# EasyEDA Pro project ProProject_IMUSensorNodes202312.epro, schematic 逆时针
Create Date: 2023-12-26; Page Name: P1; Project Name: IMUSensorNodes202312; Schematic Name: 逆时针; Update Date: 2024-01-22; Company: 嘉立创EDA; Page Size: A4; Version: V1.0
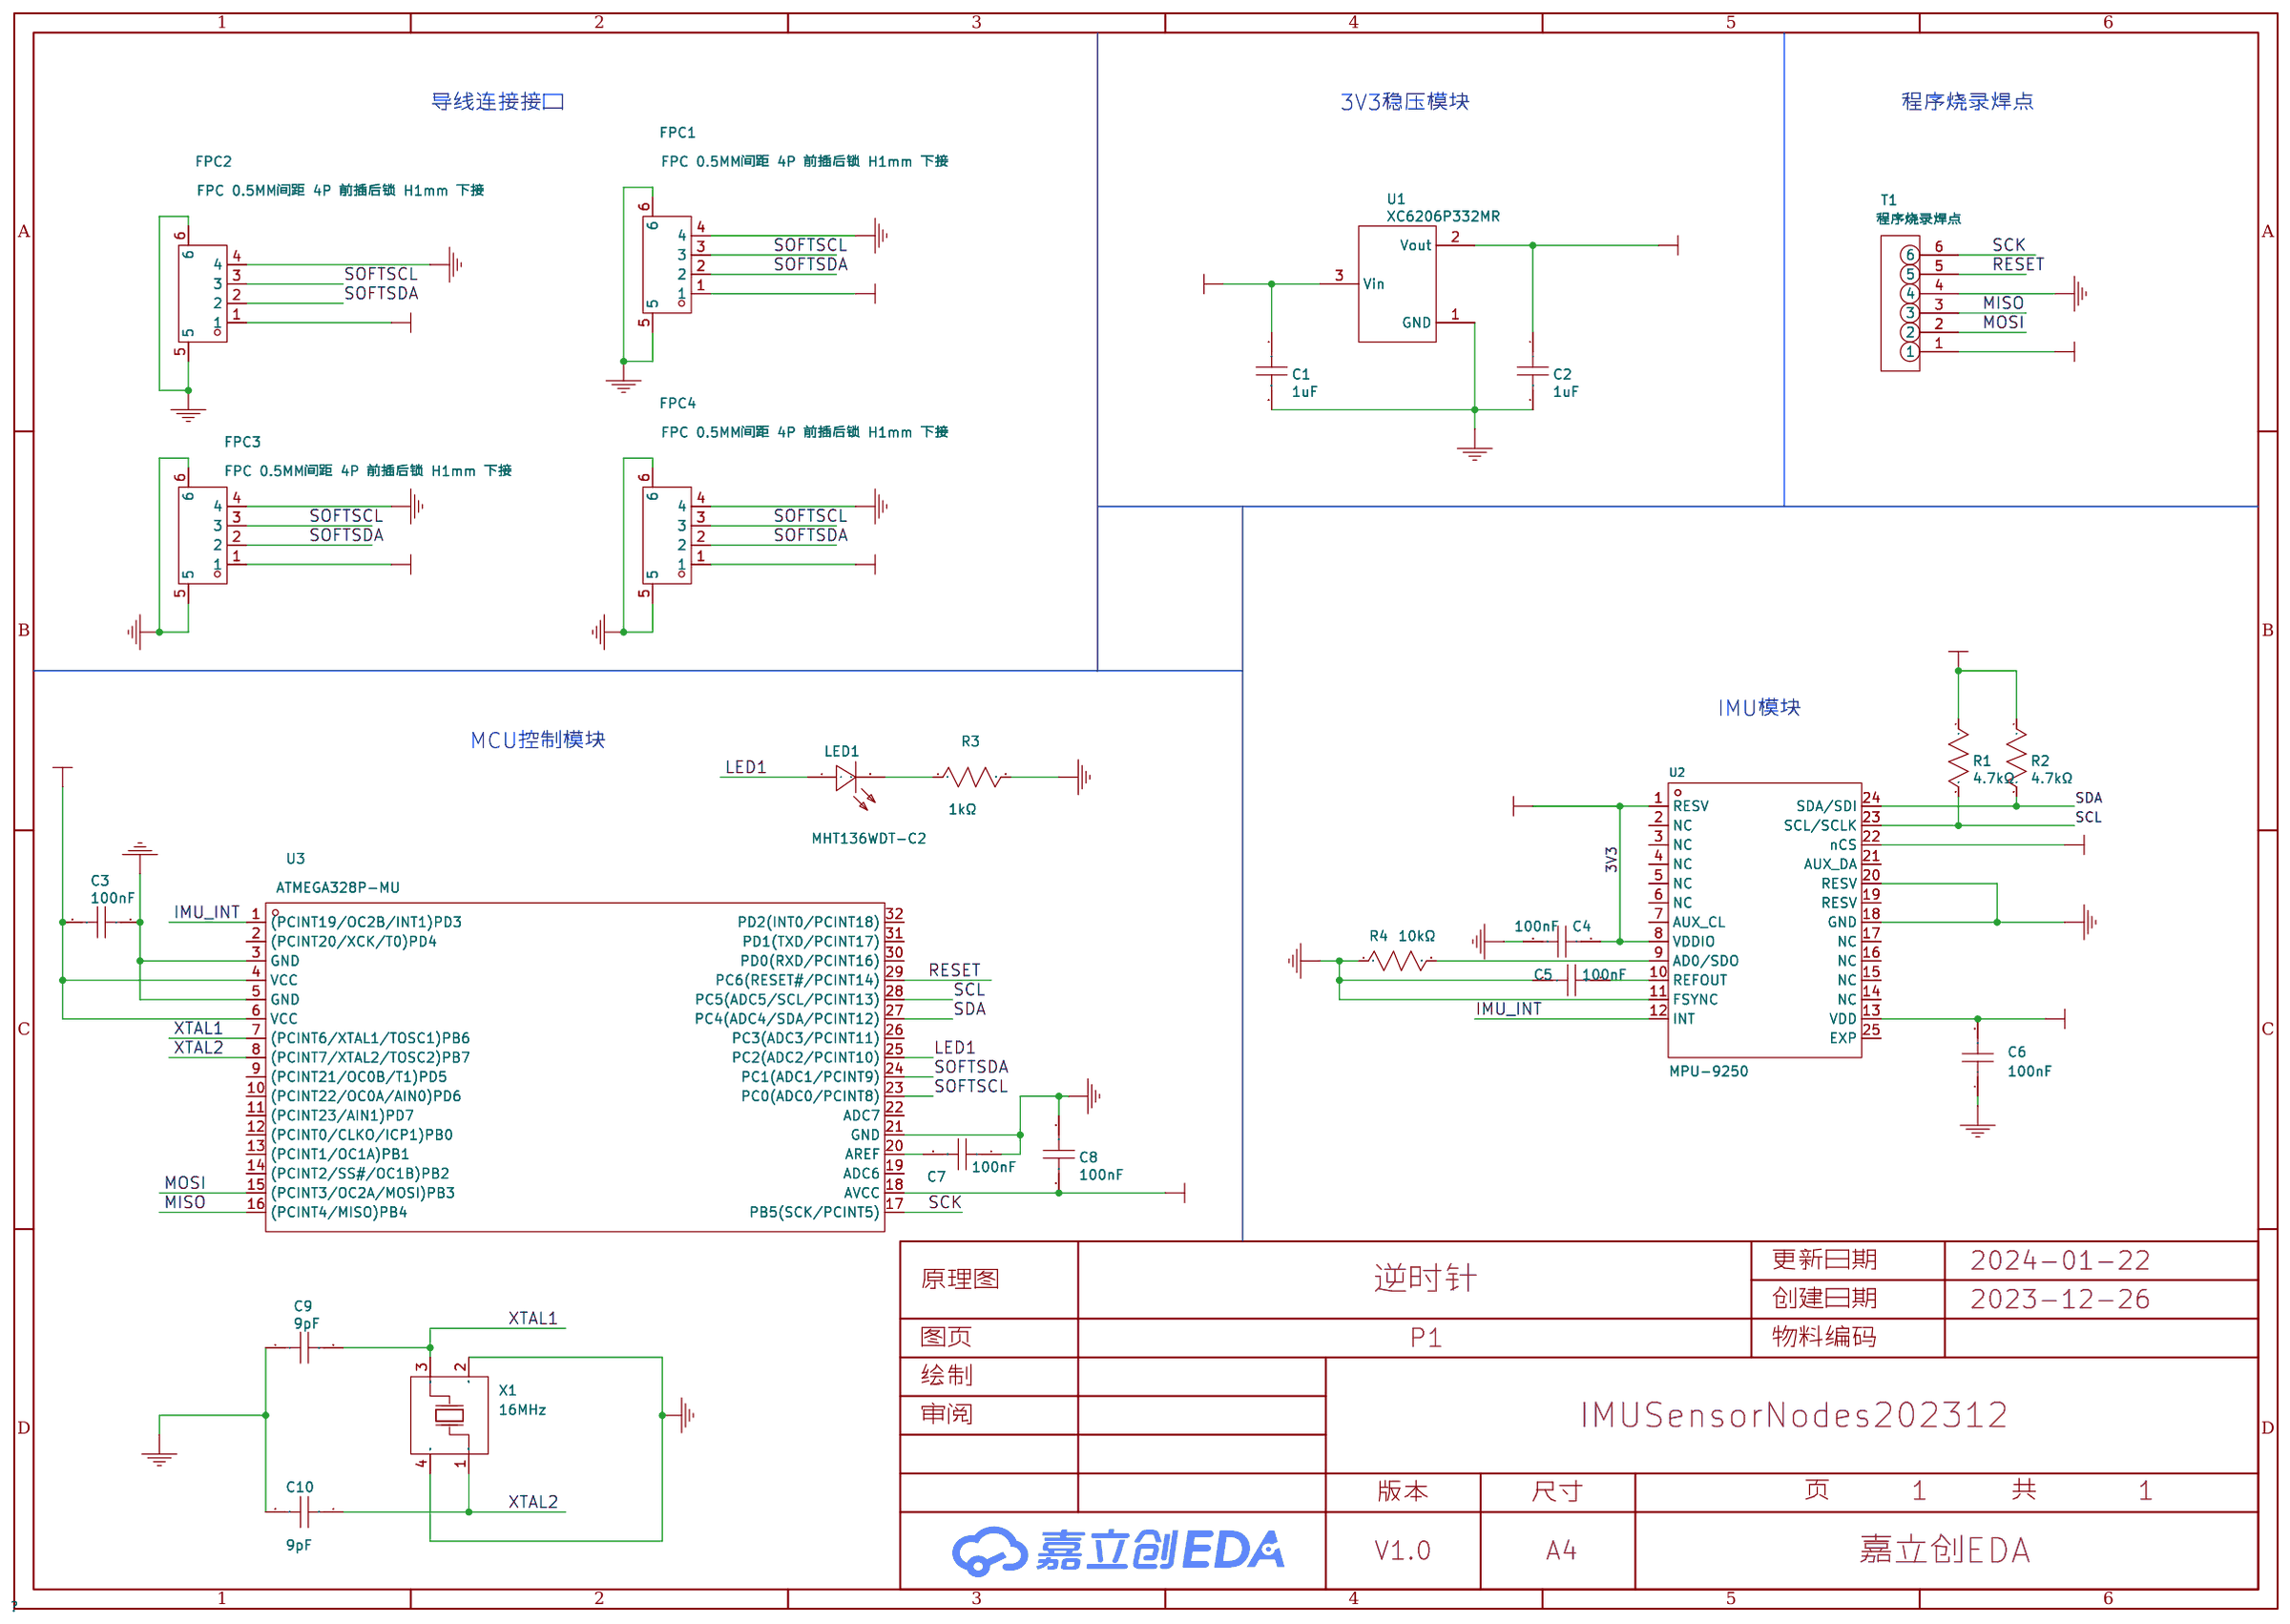
[diagram p1: schematic sheet]

## Parts
C1  1uF  [C0201]
C2  1uF  [C0201]
C3  100nF  [C0201]
C4  100nF  [C0201]
C5  100nF  [C0201]
C6  100nF  [C0201]
C7  100nF  [C0201]
C8  100nF  [C0201]
C9  9pF  [C0201]
C10  9pF  [C0201]
FPC1  FPC 0.5MM间距 4P 前插后锁 H1mm 下接  [FPC-0.5MM-4P-H1.0]
FPC2  FPC 0.5MM间距 4P 前插后锁 H1mm 下接  [FPC-0.5MM-4P-H1.0]
FPC3  FPC 0.5MM间距 4P 前插后锁 H1mm 下接  [FPC-0.5MM-4P-H1.0]
FPC4  FPC 0.5MM间距 4P 前插后锁 H1mm 下接  [FPC-0.5MM-4P-H1.0]
LED1  MHT136WDT-C2  [LED0402]
R1  4.7kΩ  [R0201]
R2  4.7kΩ  [R0201]
R3  1kΩ  [R0201]
R4  10kΩ  [R0201]
T1  程序烧录焊点  [TEST]
U1  XC6206P332MR  [SOT-23-3_L2.9-W1.6-P1.90-LS2.8-BR]
U2  MPU-9250  [QFN-24_L3.0-W3.0-P0.40-BL-EP]
U3  ATMEGA328P-MU  [VQFN-32_L5.0-W5.0-P0.50-TL-EP3.1]
X1  16MHz  [CRYSTAL-SMD_4P-L1.6-W1.2-BL]

## Library data of the parts
C1 C2 = GRM033R61A105ME44D: 容值:1uF;精度:±20%;额定电压:10V;材质(温度系数):X5R;; LCSC Part Name: 1uF ±20% 10V; Supplier Part: C76935; Manufacturer: muRata(村田); Supplier Footprint: 0201; JLCPCB Part Class: Extended Part; Datasheet: https://atta.szlcsc.com/upload/public/pdf/source/20190904/C426118_85E81C7C1F21FC87C5FB6D536E0847B4.pdf; Supplier: LCSC; Tolerance: ±20%; Voltage Rated: 10V; Temperature Coefficient: X5R; Check: true
C3-C8 = 0201X104K100NT: 容值:100nF;精度:±10%;额定电压:10V;材质(温度系数):X5R;; LCSC Part Name: 100nF ±10% 10V; Supplier Part: C284966; Manufacturer: FH(风华); Supplier Footprint: 0201; JLCPCB Part Class: Extended Part; Datasheet: https://atta.szlcsc.com/upload/public/pdf/source/20200305/C486355_26A10D38EF8C2A5C37091D0039909270.pdf; Supplier: LCSC; Tolerance: ±10%; Voltage Rated: 10V; Temperature Coefficient: X5R; Check: true
C9 C10 = GRM0335C1H9R0BA01D: 容值:9pF;额定电压:50V;材质(温度系数):C0G;; LCSC Part Name: 9pF 50V ±0.1pF; Supplier Part: C161443; Manufacturer: muRata(村田); Supplier Footprint: 0201; JLCPCB Part Class: Extended Part; Datasheet: https://atta.szlcsc.com/upload/public/pdf/source/20190418/C161443_6F26B16708DF6E91A07DC3E31260E8F5.pdf; Supplier: LCSC; Voltage Rated: 50V; Temperature Coefficient: C0G; Check: true
FPC1-FPC4 = FPC 0.5MM 4P 翻盖式 H2.0: Supplier: LCSC; Supplier Part: C9345; Manufacturer: ATOM(爱特姆); JLCPCB Part Class: Extended Part; Check: true
LED1 = MHT136WDT-C2: 发光颜色:白色;二极管配置:-;功率:95mW;透镜颜色:雾状黄透镜;主波长:-;色温:-;发光角度:130°;安装方式:-;工作温度:-35℃~+85℃;; LCSC Part Name: 白灯; Supplier Part: C397046; Manufacturer: MEIHUA(美华); Supplier Footprint: 0402; JLCPCB Part Class: Extended Part; Datasheet: https://atta.szlcsc.com/upload/public/pdf/source/20190613/C397046_5CACA7179AA86E0F80D2D379FCAA6DAE.pdf; Supplier: LCSC; Emitted Color: 白色; Forward Current: 1mA; Power Dissipation: 95mW; Lens Color: 雾状黄透镜; Viewing Angle: 130°; Operating Temperature: -35℃~+85℃; Paste Type: expand; Check: true
R1 R2 = 0201WMF4701TEE: 阻值:4.7kΩ;精度:±1%;功率:50mW;温度系数:±200ppm/℃;电阻类型:厚膜电阻;; LCSC Part Name: 4.7kΩ ±1% 50mW 厚膜电阻; Supplier Part: C270346; Manufacturer: UNI-ROYAL(厚声); Supplier Footprint: 0201; JLCPCB Part Class: Extended Part; Datasheet: https://atta.szlcsc.com/upload/public/pdf/source/20200306/C422600_1E6D84923E4A46A82E41ADD87F860B5C.pdf; Supplier: LCSC; Tolerance: ±1%; Power(Watts): 50mW; Overload Voltage (Max): 25V; Temperature Coefficient: ±200ppm/℃; Type: 厚膜电阻; Operating Temperature Range: -55℃~+155℃; Check: true
R3 = 0201WMF1001TEE: 阻值:1kΩ;精度:±1%;功率:50mW;温度系数:±200ppm/℃;电阻类型:厚膜电阻;; LCSC Part Name: 1kΩ ±1% 50mW 厚膜电阻; Supplier Part: C270365; Manufacturer: UNI-ROYAL(厚声); Supplier Footprint: 0201; JLCPCB Part Class: Extended Part; Datasheet: https://atta.szlcsc.com/upload/public/pdf/source/20200306/C422600_1E6D84923E4A46A82E41ADD87F860B5C.pdf; Supplier: LCSC; Tolerance: ±1%; Power(Watts): 50mW; Overload Voltage (Max): 25V; Temperature Coefficient: ±200ppm/℃; Type: 厚膜电阻; Operating Temperature Range: -55℃~+155℃; Check: true
R4 = 0201WMF1002TEE: 阻值:10kΩ;精度:±1%;功率:50mW;温度系数:±200ppm/℃;电阻类型:厚膜电阻;; LCSC Part Name: 10kΩ ±1% 50mW 厚膜电阻; Supplier Part: C473048; Manufacturer: UNI-ROYAL(厚声); Supplier Footprint: 0201; JLCPCB Part Class: Extended Part; Datasheet: https://atta.szlcsc.com/upload/public/pdf/source/20200306/C422600_1E6D84923E4A46A82E41ADD87F860B5C.pdf; Supplier: LCSC; Tolerance: ±1%; Power(Watts): 50mW; Overload Voltage (Max): 25V; Temperature Coefficient: ±200ppm/℃; Type: 厚膜电阻; Operating Temperature Range: -55℃~+155℃; Check: true
T1 = 程序烧录焊点: Check: true
U1 = XC6206P332MR_C5148692: 输出类型:固定;最大输入电压:8V;输出电压:3.3V;输出电流:300mA;输出极性:正;; LCSC Part Name: 输入8V 输出3.3V 300mA; Supplier Part: C5148692; Manufacturer: HXY MOSFET(华轩阳电子); Supplier Footprint: SOT-23; JLCPCB Part Class: Extended Part; Datasheet: https://atta.szlcsc.com/upload/public/pdf/source/20230315/7D5B35EFFBBF81C2EFC36318D2A1A670.pdf; Supplier: LCSC; Output Type: 固定; Maximum Input Voltage: 8V; Output Voltage: 3.3V; Output Current: 300mA; Dropout Voltage: 240mV@(50mA); Output Polarity: 正; Number of Outputs: 1; Paste Type: base; image: //image.lceda.cn/szlcsc/C5446.jpg; Check: true
U2 = MPU-9250: 9轴传感器; LCSC Part Name: 停产; Supplier Part: C71459; Manufacturer: TDK InvenSense(应美盛); Supplier Footprint: QFN-24-EP(3x3); JLCPCB Part Class: Extended Part; Datasheet: https://atta.szlcsc.com/upload/public/pdf/source/20170810/C71459_1502335389644879978.pdf; Supplier: LCSC; Check: true
U3 = ATMEGA328P-MU_C7499261: CPU内核:AVR;CPU最大主频:2MHz;工作电压范围:1.8V~5.5V;GPIO端口数量:23;; Supplier Part: C7499261; Manufacturer: MICROCHIP(美国微芯); Supplier Footprint: QFN-32; JLCPCB Part Class: Extended Part; Datasheet: https://atta.szlcsc.com/upload/public/pdf/source/20230908/85D6DA5391498C20E7706F0832EC6BD4.pdf; Supplier: LCSC; CPU Core: AVR; CPU Maximum Speed: 2MHz; Operating Voltage Range: 1.8V~5.5V; GPIO Ports Number: 23; ADC (Bit): 10bit; Direct Memory Access: 有; Operating Temperature Range: -40℃~+85℃; Paste Type: base; image: //image.lceda.cn/szlcsc/C14877.jpg; Check: true
X1 = X1E0002510046: 频率:24MHz;负载电容:12pF;频率公差:±10ppm;; LCSC Part Name: 24MHz ±10ppm 12pF; Supplier Part: C255976; Manufacturer: EPSON(爱普生); Supplier Footprint: SMD1612-4P; JLCPCB Part Class: 扩展库; Datasheet: https://atta.szlcsc.com/upload/public/pdf/source/20180822/C255989_0BB83C3C7C0C9918239585ECA8E4BE51.pdf; Supplier: LCSC; Crystal Type: 贴片无源晶振; Load Capacitance: 12pF; Equivalent Series Resistance (ESR): 200Ω; Frequency Tolerance: ±10ppm; Operating Temperature: -40℃~+85℃; Check: true

## Nets
3V3: C2.1 C3.1 C4.1 C6.2 C8.1 R1.1 R2.1 U1.2(Vout) U2.1(RESV) U2.8(VDDIO) U2.13(VDD) U2.22(nCS) U3.4(VCC) U3.6(VCC) U3.18(AVCC)
5V: C1.1 FPC1.1 FPC2.1 FPC3.1 FPC4.1 T1.1 U1.3(Vin)
GND: C1.2 C2.2 C3.2 C4.2 C5.1 C6.1 C7.1 C8.2 C9.1 C10.2 FPC1.4 FPC1.5 FPC1.6 FPC2.4 FPC2.5 FPC2.6 FPC3.4 FPC3.5 FPC3.6 FPC4.4 FPC4.5 FPC4.6 R3.2 R4.1 T1.4 U1.1(GND) U2.11(FSYNC) U2.18(GND) U2.20(RESV) U3.3(GND) U3.5(GND) U3.21(GND) X1.2(GND) X1.4(GND)
IMU_INT: U2.12(INT) U3.1((PCINT19/OC2B/INT1)PD3)
LED1: LED1.1(A) U3.25(PC2(ADC2/PCINT10))
MISO: T1.3 U3.16((PCINT4/MISO)PB4)
MOSI: T1.2 U3.15((PCINT3/OC2A/MOSI)PB3)
RESET: T1.5 U3.29(PC6(RESET#/PCINT14))
SCK: T1.6 U3.17(PB5(SCK/PCINT5))
SCL: R1.2 U2.23(SCL/SCLK) U3.28(PC5(ADC5/SCL/PCINT13))
SDA: R2.2 U2.24(SDA/SDI) U3.27(PC4(ADC4/SDA/PCINT12))
SOFTSCL: FPC1.3 FPC2.3 FPC3.3 FPC4.3 U3.23(PC0(ADC0/PCINT8))
SOFTSDA: FPC1.2 FPC2.2 FPC3.2 FPC4.2 U3.24(PC1(ADC1/PCINT9))
XTAL1: C9.2 U3.7((PCINT6/XTAL1/TOSC1)PB6) X1.3(OSC2)
XTAL2: C10.1 U3.8((PCINT7/XTAL2/TOSC2)PB7) X1.1(OSC1)
$1N1083: LED1.2(K) R3.1
$1N1108: C7.2 U3.20(AREF)
$1N1698: R4.2 U2.9(AD0/SDO)
$1N1725: C5.2 U2.10(REFOUT)

Not connected (* = marked no-connect by the designer): U2 2(NC) 3(NC) 4(NC) 5(NC) 6(NC) 7(AUX_CL) 14(NC) 15(NC) 16(NC) 17(NC) 19(RESV) 21(AUX_DA) 25(EXP); U3 2((PCINT20/XCK/T0)PD4) 9((PCINT21/OC0B/T1)PD5) 10((PCINT22/OC0A/AIN0)PD6) 11((PCINT23/AIN1)PD7) 12((PCINT0/CLKO/ICP1)PB0) 13((PCINT1/OC1A)PB1) 14((PCINT2/SS#/OC1B)PB2) 19(ADC6) 22(ADC7) 26(PC3(ADC3/PCINT11)) 30(PD0(RXD/PCINT16)) 31(PD1(TXD/PCINT17)) 32(PD2(INT0/PCINT18))

## Notes on the sheet
- 导线连接接口
- 3V3稳压模块
- 程序烧录焊点
- IMU模块
- MCU控制模块
